# EasyEDA Pro project MSDRV3.eprj, board PCB8
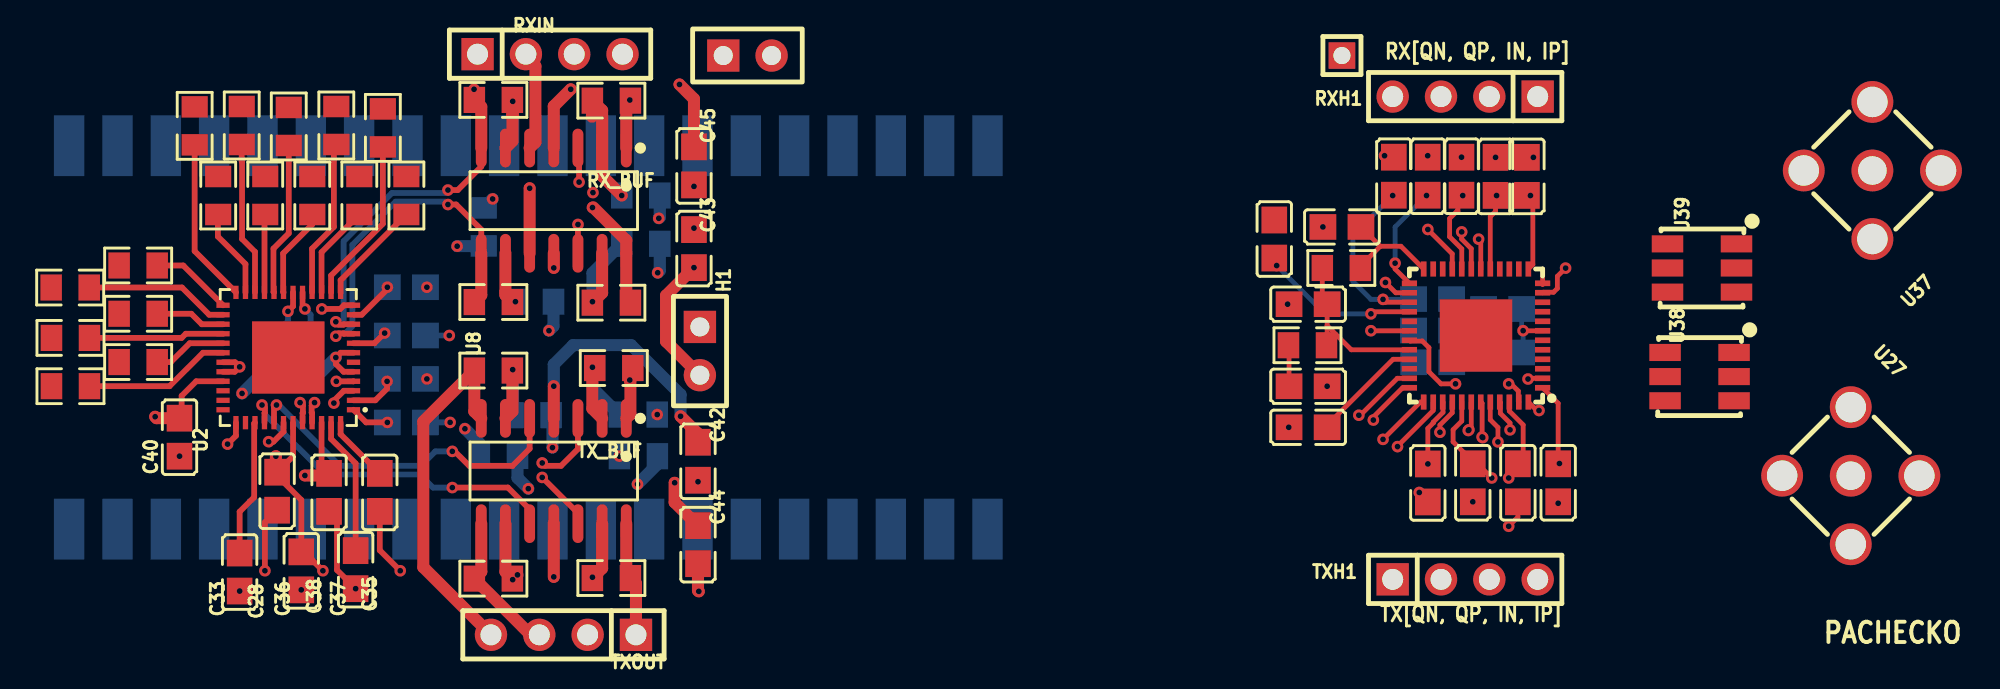
[diagram p14: board, top side]
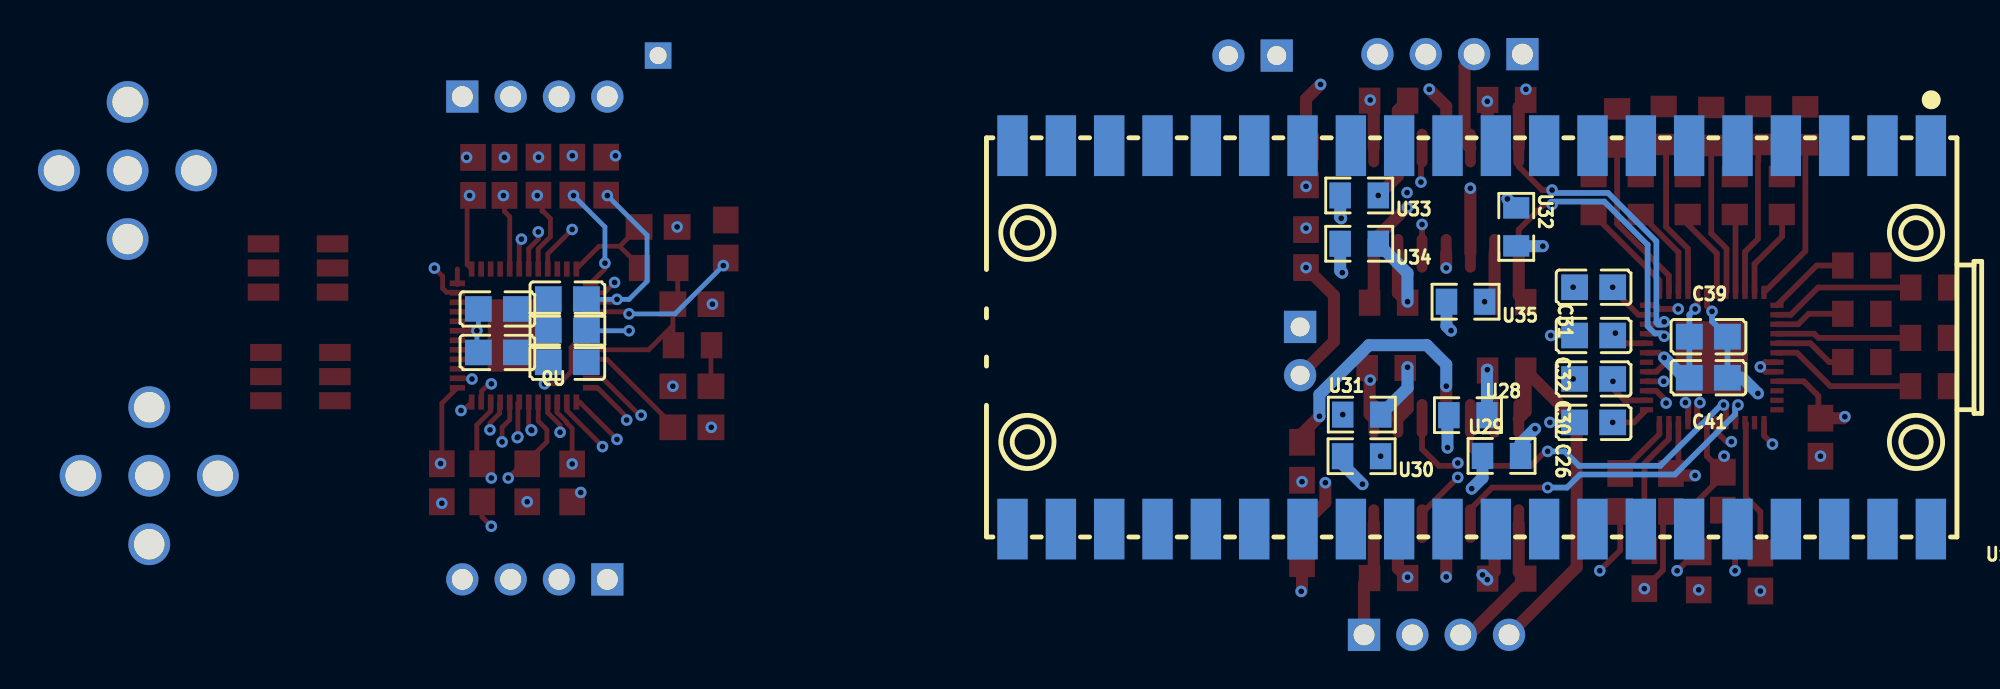
[diagram p15: board, bottom side, seen from below]

No outline. copper layers: Top Layer, Inner1, Inner2, Inner3, Inner4, Bottom Layer. Coordinates in mm from the lowest, leftmost part position.
Stack: Top Layer 0.035mm 外层铜厚1oz / Dielectric1 0.0994mm 3313 RC57% 4.2mil / Inner1 0.0152mm 内层铜厚 / Dielectric2 0.55mm 0.55mm H/H不含铜 / Inner2 0.0152mm 内层铜厚 / Dielectric3 0.1088mm 2116 RC54% 4.9mil / Inner3 0.0152mm 内层铜厚 / Dielectric4 0.55mm 0.55mm H/H不含铜 / Inner4 0.0152mm 内层铜厚 / Dielectric5 0.0994mm 3313 RC57% 4.2mil / Bottom Layer 0.035mm 外层铜厚1oz

## Design rules (mm)
template: JLCPCB Capability(Two Layers Board)
spacing copperThickness1oz (default): track to track 0.102, other pairs 0.152 to 0.3
spacing copperThickness2oz: track to track 0.203, other pairs 0.152 to 0.3
track width copperThickness1oz (default): min 0.127, default 0.254, max 2.54
track width copperThickness2oz: min 0.203, default 0.254, max 2.54
differential pair differentialPair (default): width min 0.127, default 0.254, max 2.54; gap min 0.152, default 0.152
via viaSize (default): diameter min 0.5, default 0.61, max 10; hole min 0.3, default 0.305, max 6.3

## Placement (name value [footprint] x y rotation side)
C18  100nF  [C0805]  65.06 10.92 0 top
C19  100nF  [C0805]  63.28 20.82 270 top
C20  100pF  [C0805]  66.83 21.46 0 top
C21  2200pF  [C0805]  65.06 13.08 180 top
C22  68pF  [C0805]  65.06 17.39 0 top
C26  330nF  [C0805]  17.67 11.18 180 bottom
C28  100nF  [C0805]  10.87 7.56 90 top
C30  100nF  [C0805]  17.67 13.46 0 bottom
C31  100nF  [C0805]  17.67 18.29 180 bottom
C32  100nF  [C0805]  17.67 15.75 180 bottom
C33  100nF  [C0805]  8.91 3.3 270 top
C35  330nF  [C0805]  16.27 7.49 270 top
C36  100nF  [C0805]  12.14 3.37 90 top
C37  330nF  [C0805]  15 3.43 90 top
C38  100nF  [C0805]  13.6 7.49 90 top
C39  100nF  [C0805]  11.64 15.68 180 bottom
C40  100nF  [C0805]  5.75 10.4 90 top
C41  100nF  [C0805]  11.64 13.53 180 bottom
C42  330nF  [C0805]  32.99 9.13 90 top
C43  330nF  [C0805]  32.78 20.32 270 top
C44  330nF  [C0805]  32.99 4.74 270 top
C45  330nF  [C0805]  32.78 24.67 90 top
CLNA  100pF  [C0805]  78.2 8 270 top
CPA  100nF  [C0805]  76.56 24.12 90 top
CPA1  10uF  [C0805]  75.28 17.14 180 bottom
CPA2  10uF  [C0805]  75.28 14.86 180 bottom
CPLL  100pF  [C0805]  73.12 24.13 90 top
CRXMX  100pF  [C0805]  76.08 8 270 top
CTXMX  100pF  [C0805]  74.91 24.12 90 top
CVCCCP  10nF  [C0805]  71.34 24.13 90 top
CVCO0  100pF  [C0805]  71.6 17.66 0 bottom
CVCO1  100pF  [C0805]  71.6 16.01 0 bottom
CVCO2  100pF  [C0805]  71.6 14.34 0 bottom
CVRXA  100pF  [C0805]  71.35 7.99 270 top
CVRXF  100pF  [C0805]  73.71 8 270 top
CVXTAL  100pF  [C0805]  69.56 24.13 90 top
H1  -  [HDR-TH_2P-P2.54-V-F]  33.09 14.93 270 top
H12  -  [HDR-TH_1P-V-M_XKB_X4611WV-01I-C28D40]  66.83 30.48 180 top
H21  -  [HDR-TH_2P-P2.54-V-F]  35.59 30.48 0 top
RX_BUF  CLC4601ISO14X  [SOIC-14_L8.7-W3.9-P1.27-LS6.0-BL]  25.41 22.84 180 top
RXH1  -  [HDR-TH_4P-P2.54-V-M]  73.31 28.32 180 top
RXIN  -  [HDR-TH_4P-P2.54-V-F]  25.22 30.55 0 top
TX_BUF  CLC4601ISO14X  [SOIC-14_L8.7-W3.9-P1.27-LS6.0-BL]  25.41 8.62 180 top
TXH1  -  [HDR-TH_4P-P2.54-V-M]  73.31 2.92 0 top
TXOUT  -  [HDR-TH_4P-P2.54-V-F]  25.92 0 180 top
U1  PICO  [COMM-SMD_L51.0-W21.0-P2.54_SC0916]  24.39 15.65 0 bottom
U2  MAX5864ETM+  [QFN-48_L7.0-W7.0-P0.50-BL-EP5.1]  11.46 14.59 90 top
U3  1120  [R0805]  22.24 2.96 0 top
U4  1120  [R0805]  28.44 28.1 0 top
U5  1120  [R0805]  28.44 17.47 180 top
U6  1120  [R0805]  22.24 17.51 0 top
U7  1120  [R0805]  22.24 28.14 180 top
U8  1120  [R0805]  22.24 13.9 180 top
U9  MAX2831ETM+T  [TQFN-48_L7.0-W7.0-P0.50-TL-EP5.6]  73.88 15.75 180 top
U10  1120  [R0805]  28.44 2.99 180 top
U11  100  [R0805]  0.02 13.08 0 top
U12  100  [R0805]  3.57 14.35 0 top
U13  100  [R0805]  0.02 15.62 0 top
U14  100  [R0805]  3.57 16.89 0 top
U15  100  [R0805]  0 18.27 0 top
U16  100  [R0805]  3.57 19.43 0 top
U17  100  [R0805]  6.54 26.78 90 top
U18  100  [R0805]  7.78 23.11 90 top
U19  100  [R0805]  9.01 26.8 90 top
U20  100  [R0805]  10.25 23.11 90 top
U21  100  [R0805]  11.49 26.75 90 top
U22  100  [R0805]  12.72 23.11 90 top
U23  100  [R0805]  13.99 26.8 90 top
U24  100  [R0805]  15.2 23.11 90 top
U25  100  [R0805]  16.43 26.67 90 top
U26  100  [R0805]  17.67 23.11 90 top
U27  MCX5.08-H5  [SMA-TH_MCX5.08-H5]  93.57 8.37 315 top
U28  1120  [R0805]  24.27 11.56 0 bottom
U29  1120  [R0805]  22.51 9.41 180 bottom
U30  1120  [R0805]  29.86 9.4 0 bottom
U31  1120  [R0805]  29.85 11.59 180 bottom
U32  1120  [R0805]  21.73 21.46 270 bottom
U33  1120  [R0805]  29.99 23.11 0 bottom
U34  1120  [R0805]  29.99 20.57 0 bottom
U35  1120  [R0805]  24.4 17.53 0 bottom
U36  1120  [R0805]  28.57 14.04 0 top
U37  MCX5.08-H5  [SMA-TH_MCX5.08-H5]  94.71 24.43 45 top
U38  TCM2-43X+  [IND-SMD_6P-L4.1-W3.8-P1.27-TL]  85.63 13.58 270 top
U39  TCM2-43X+  [IND-SMD_6P-L4.1-W3.8-P1.27-TL]  85.76 19.3 270 top
U40  1.2K  [R0805]  65.02 15.24 180 top
U41  750  [R0805]  66.8 19.3 0 top

## Footprints (pads in the part's own frame, mm; a bottom-side part is the same pattern mirrored in y, then rotated)
C0805
  rect 1.41x1.35 smd: 1(-1,0) 2(1,0)
COMM-SMD_L51.0-W21.0-P2.54_SC0916
  rect 1.6x3.2 smd: 1(-24.445,-10.088) 2(-21.905,-10.088) 3(-19.365,-10.088) 4(-16.825,-10.088) 5(-14.285,-10.088) 6(-11.745,-10.088) 7(-9.205,-10.088) 8(-6.665,-10.088) 9(-4.125,-10.088) 10(-1.585,-10.088) 11(0.955,-10.088) 12(3.495,-10.088) 13(6.035,-10.088) 14(8.575,-10.088) 15(11.115,-10.088) 16(13.655,-10.088) 17(16.195,-10.088) 18(18.735,-10.088) 19(21.275,-10.088) 20(23.815,-10.088) 21(23.815,10.088) 22(21.275,10.088) 23(18.735,10.088) 24(16.195,10.088) 25(13.655,10.088) 26(11.115,10.088) 27(8.575,10.088) 28(6.035,10.088) 29(3.495,10.088) 30(0.955,10.088) 31(-1.585,10.088) 32(-4.125,10.088) 33(-6.665,10.088) 34(-9.205,10.088) 35(-11.745,10.088) 36(-14.285,10.088) 37(-16.825,10.088) 38(-19.365,10.088) 39(-21.905,10.088) 40(-24.445,10.088)
HDR-TH_1P-V-M_XKB_X4611WV-01I-C28D40
  rect 1.4x1.4 hole 0.9: 1(0,0)
HDR-TH_2P-P2.54-V-F
  rect 1.7x1.7 hole 1: 1(-1.27,0)
  round 1.7 hole 1: 2(1.27,0)
HDR-TH_4P-P2.54-V-F
  rect 1.7x1.7 hole 1.1: 1(-3.81,0)
  round 1.7 hole 1.1: 2(-1.27,0) 3(1.27,0) 4(3.81,0)
HDR-TH_4P-P2.54-V-M
  rect 1.7x1.7 hole 1.1: 1(-3.81,0)
  round 1.7 hole 1.1: 2(-1.27,0) 3(1.27,0) 4(3.81,0)
IND-SMD_6P-L4.1-W3.8-P1.27-TL
  rect 0.9x1.657 smd: 1(-1.27,1.813) 2(0,1.813) 3(1.27,1.813) 4(1.27,-1.813) 5(0,-1.813) 6(-1.27,-1.813)
QFN-48_L7.0-W7.0-P0.50-BL-EP5.1
  rect 0.28x0.7 smd: 1(-2.75,-3.428) 2(-2.25,-3.428) 3(-1.75,-3.428) 4(-1.25,-3.428) 5(-0.75,-3.428) 6(-0.25,-3.428) 7(0.25,-3.428) 8(0.75,-3.428) 9(1.25,-3.428) 10(1.75,-3.428) 11(2.25,-3.428) 12(2.75,-3.428) 25(2.75,3.428) 26(2.25,3.428) 27(1.75,3.428) 28(1.25,3.428) 29(0.75,3.428) 30(0.25,3.428) 31(-0.25,3.428) 32(-0.75,3.428) 33(-1.25,3.428) 34(-1.75,3.428) 35(-2.25,3.428) 36(-2.75,3.428)
  rect 0.7x0.28 smd: 13(3.428,-2.75) 14(3.428,-2.25) 15(3.428,-1.75) 16(3.428,-1.25) 17(3.428,-0.75) 18(3.428,-0.25) 19(3.428,0.25) 20(3.428,0.75) 21(3.428,1.25) 22(3.428,1.75) 23(3.428,2.25) 24(3.428,2.75) 37(-3.428,2.75) 38(-3.428,2.25) 39(-3.428,1.75) 40(-3.428,1.25) 41(-3.428,0.75) 42(-3.428,0.25) 43(-3.428,-0.25) 44(-3.428,-0.75) 45(-3.428,-1.25) 46(-3.428,-1.75) 47(-3.428,-2.25) 48(-3.428,-2.75)
  rect 3.81x3.81 smd: 49(0,0)
R0805
  rect 1.133x1.377 smd: 1(-1,0) 2(1,0)
SMA-TH_MCX5.08-H5
  round 2.2 hole 1.6: 1(-2.55,-2.55) 2(-2.55,2.55) 3(2.55,2.55) 4(2.55,-2.55)
  round 2.2 hole 1.5: 5(0,0)
SOIC-14_L8.7-W3.9-P1.27-LS6.0-BL
  oval 0.574x2.038 smd: 1(-3.81,-2.769) 2(-2.54,-2.769) 3(-1.27,-2.769) 4(0,-2.769) 5(1.27,-2.769) 6(2.54,-2.769) 7(3.81,-2.769) 8(3.81,2.769) 9(2.54,2.769) 10(1.27,2.769) 11(0,2.769) 12(-1.27,2.769) 13(-2.54,2.769) 14(-3.81,2.769)
TQFN-48_L7.0-W7.0-P0.50-TL-EP5.6
  rect 0.8x0.3 smd: 1(-3.5,2.751) 2(-3.5,2.251) 3(-3.5,1.75) 4(-3.5,1.251) 5(-3.5,0.75) 6(-3.5,0.252) 7(-3.5,-0.249) 8(-3.5,-0.75) 9(-3.5,-1.25) 10(-3.5,-1.75) 11(-3.5,-2.249) 12(-3.5,-2.748) 25(3.5,-2.748) 26(3.5,-2.249) 27(3.5,-1.75) 28(3.5,-1.25) 29(3.5,-0.75) 30(3.5,-0.249) 31(3.5,0.252) 32(3.5,0.75) 33(3.5,1.251) 34(3.5,1.75) 35(3.5,2.251) 36(3.5,2.751)
  rect 0.3x0.8 smd: 13(-2.751,-3.5) 14(-2.251,-3.5) 15(-1.75,-3.5) 16(-1.25,-3.5) 17(-0.75,-3.5) 18(-0.251,-3.5) 19(0.249,-3.5) 20(0.75,-3.5) 21(1.25,-3.5) 22(1.75,-3.5) 23(2.251,-3.5) 24(2.751,-3.5) 37(2.751,3.5) 38(2.251,3.5) 39(1.75,3.5) 40(1.25,3.5) 41(0.75,3.5) 42(0.251,3.5) 43(-0.251,3.5) 44(-0.75,3.5) 45(-1.25,3.5) 46(-1.75,3.5) 47(-2.251,3.5) 48(-2.751,3.5)
  rect 3.81x3.81 smd: 49(0,0.001)

## Nets
+5V: C42.2 C45.2 H1.1 RX_BUF.4 TX_BUF.4
-5V: C43.2 C44.2 H1.2 RX_BUF.11 TX_BUF.11
GND: C18.1 C20.1 C21.1 C22.1 C26.1 C28.1 C30.2 C31.1 C32.1 C33.2 C35.2 C36.1 C37.1 C38.1 C39.1 C40.1 C41.1 C42.1 C43.1 C44.1 C45.1 CLNA.2 CPA.2 CPA1.2 CPA2.2 CPLL.2 CRXMX.2 CTXMX.2 CVCCCP.2 CVCO0.2 CVCO1.2 CVCO2.2 CVRXA.2 CVRXF.2 CVXTAL.2 U2.5 U2.7 U2.12 U2.17 U2.31 U2.32 U2.37 U2.42 U9.2 U9.26 U9.31 U9.47 U27.1 U27.2 U27.3 U27.4 U28.2 U29.2 U30.2 U31.1 U32.2 U33.2 U34.2 U35.2 U37.1 U37.2 U37.3 U37.4 U38.1 U38.2 U39.1 U39.2
3.3: C28.2 C30.1 C31.2 C32.2 C33.1 C36.2 C38.2 C39.2 C40.2 C41.2 CLNA.1 CPA.1 CPA1.1 CPA2.1 CPLL.1 CRXMX.1 CTXMX.1 CVCCCP.1 CVCO0.1 CVCO1.1 CVCO2.1 CVRXA.1 CVRXF.1 CVXTAL.1 U2.2 U2.8 U2.11 U2.18 U2.33 U2.39 U2.43 U2.46 U9.1 U9.7 U9.13 U9.17 U9.20 U9.25 U9.27 U9.30 U9.39 U9.41 U9.46
$1I595/BYPASS: C18.2 U9.33
$1I595/CLKBUF: H12.1 U9.21
$1I595/CPOUT: C20.2 U9.24 U41.2
$1I595/CS#: U9.15
$1I595/D1: U9.23
$1I595/D2: U9.11
$1I595/D3: U9.8
$1I595/D4: U9.34
$1I595/D5: U9.14
$1I595/D6: U9.3
$1I595/D7: U9.6
$1I595/DIN: U9.19
$1I595/PLL_LOCK: U9.22
$1I595/PLLCLK: C19.1 H21.2
$1I595/RSSI: U9.16
$1I595/RXHP: U9.40
$1I595/RXIN: RXH1.2 U9.37
$1I595/RXIP: RXH1.1 U9.38
$1I595/RXN: U9.5 U38.6
$1I595/RXP: U9.4 U38.4
$1I595/RXQN: RXH1.4 U9.35
$1I595/RXQP: RXH1.3 U9.36
$1I595/RXTX_MODE: U9.48
$1I595/SCLK: U9.18
$1I595/SHDN#: U9.12
$1I595/TUNE: C22.2 U9.32 U40.1 U41.1
$1I595/TXIN: TXH1.3 U9.44
$1I595/TXIP: TXH1.4 U9.45
$1I595/TXN: U9.10 U39.6
$1I595/TXP: U9.9 U39.4
$1I595/TXQN: TXH1.1 U9.42
$1I595/TXQP: TXH1.2 U9.43
$1I595/XTAL: C19.2 U9.28
$1I715/BBC_CLK: U2.6
$1I715/BBC_DA0: U26.2
$1I715/BBC_DA1: U25.2
$1I715/BBC_DA2: U24.2
$1I715/BBC_DA3: U23.2
$1I715/BBC_DA4: U22.2
$1I715/BBC_DA5: U21.2
$1I715/BBC_DA6: U20.2
$1I715/BBC_DA7: U19.2
$1I715/BBC_DD0: U18.2
$1I715/BBC_DD1: U17.2
$1I715/BBC_DD2: U16.1
$1I715/BBC_DD3: U15.1
$1I715/BBC_DD4: U14.1
$1I715/BBC_DD5: U13.1
$1I715/BBC_DD6: U12.1
$1I715/BBC_DD7: U11.1
$1I715/BBC_IN: TX_BUF.12 U2.44
$1I715/BBC_IP: TX_BUF.3 U2.45
$1I715/BBC_QN: TX_BUF.10 U2.40
$1I715/BBC_QP: TX_BUF.5 U2.41
$1I715/CS: U2.36
$1I715/DIN: U2.34
$1I715/RX_BBCIN: RX_BUF.1 U2.4 U4.2
$1I715/RX_BBCIP: RX_BUF.14 U2.3 U5.1
$1I715/RX_BBCQN: RX_BUF.8 U2.9 U6.1
$1I715/RX_BBCQP: RX_BUF.7 U2.10 U7.2
$1I715/RXIN: RX_BUF.3 RXIN.4
$1I715/RXIP: RX_BUF.12 RXIN.3
$1I715/RXQN: RX_BUF.10 RXIN.1
$1I715/RXQP: RX_BUF.5 RXIN.2
$1I715/SCLK: U2.35
$1I715/TXIN: TX_BUF.14 TXOUT.1 U10.1
$1I715/TXIP: TX_BUF.1 TXOUT.2 U36.2
$1I715/TXQN: TX_BUF.8 TXOUT.3 U3.1
$1I715/TXQP: TX_BUF.7 TXOUT.4 U8.2
$1I595/$1N13355: U27.5 U38.3
$1I595/$1N19235: H21.1
$1I595/$1N20170: U37.5 U39.3
$1I595/$1N20400: C21.2 U40.2
$1I715/$1N3982: C37.2 U2.47
$1I715/$1N8783: RX_BUF.2 U4.1 U33.1
$1I715/$1N8787: RX_BUF.6 U7.1 U32.1
$1I715/$1N8791: RX_BUF.9 U6.2 U35.1
$1I715/$1N8799: RX_BUF.13 U5.2 U34.1
$1I715/$1N9382: TX_BUF.2 U31.2 U36.1
$1I715/$1N9385: TX_BUF.6 U8.1 U28.1
$1I715/$1N9388: TX_BUF.13 U10.2 U30.1
$1I715/$1N9391: TX_BUF.9 U3.2 U29.1
$1I715/$1N10591: U2.30 U11.2
$1I715/$1N10629: U2.29 U12.2
$1I715/$1N10667: U2.28 U13.2
$1I715/$1N10705: U2.27 U14.2
$1I715/$1N10743: U2.26 U15.2
$1I715/$1N10781: U2.25 U16.2
$1I715/$1N10830: U2.24 U17.1
$1I715/$1N10868: U2.23 U18.1
$1I715/$1N10906: U2.22 U19.1
$1I715/$1N10944: U2.21 U20.1
$1I715/$1N10982: U2.20 U21.1
$1I715/$1N11020: U2.19 U22.1
$1I715/$1N11058: U2.16 U23.1
$1I715/$1N11162: U2.15 U24.1
$1I715/$1N11200: U2.14 U25.1
$1I715/$1N11238: U2.13 U26.1
$1I715/$1N11679: C35.1 U2.48
$1I715/$1N11690: C26.2 U2.1

Pads without a net: U1 1 2 3 4 5 6 7 8 9 10 11 12 13 14 15 16 17 18 19 20 21 22 23 24 25 26 27 28 29 30 31 32 33 34 35 36 37 38 39 40; U2 38 49; U9 29 49; U38 5; U39 5

## Via types
v1: diameter 0.61, hole 0.305, Top Layer to Bottom Layer, 128 vias

## Routing (per net, layer and track width the routed paths; a pad name or vN(x,y) marks a point on that pad's centre or on a via; arc(x,y) is an arc through that point)
+5V: length 47
  Top Layer w0.635: v1(26.31,28.7) 25.41,27.81 RX_BUF.4 ; v1(32.08,11.5) 32.95,10.63 32.95,10.13 ; v1(32.02,28.96) 32.78,28.19 C45.2 ; TX_BUF.4 v1(25.41,13.08)
  Inner2 w0.635: v1(32.02,28.96) 26.56,28.96 v1(26.31,28.7)
  Inner3 w0.635: v1(32.02,28.96) 32.4,28.96 34.49,26.87 34.49,17.6 H1.1 31.44,14.55 31.44,12.52 32.08,11.88 v1(32.08,11.5)
  Bottom Layer w0.635: v1(32.08,11.5) 32.08,12.64 29.48,15.24 26.43,15.24 25.41,14.22 v1(25.41,13.08)
-5V: length 41.4
  Top Layer w0.635: v1(33.04,2.29) 32.99,2.33 C44.2 ; v1(25.42,19.3) 25.42,20.07 ; v1(32.78,19.32) 31.32,17.85 31.32,15.44 H1.2 ; 25.41,3.05 TX_BUF.11
  Inner2 w0.635: v1(33.04,2.29) 29.61,2.29 29.23,1.91 26.81,1.91 25.67,3.05 v1(25.42,3.05) ; v1(25.42,19.3) 26.81,20.7 31.4,20.7 v1(32.78,19.32)
  Inner3 w0.635: v1(33.04,2.29) 34.49,3.74 34.49,11.88 33.09,13.28 H1.2
GND: length 52.7
  Top Layer w0.254: U9.2 76.85,13.5 76.82,13.46 v1(76.61,13.46) ; U9.26 69.66,18 v1(69.12,18.54) ; v1(75.6,5.71) 76.08,6.2 CRXMX.2 ; v1(72.8,13.2) 72.04,13.2 71.41,13.84 71.41,15.11 71.06,15.45 70.42,15.45 U9.31 ; 76.13,12.25 76.11,12.27 76.11,12.82 75.72,13.2 v1(75.6,13.2)
  Top Layer w0.305: v1(15,2.43) 14.02,3.41 14.02,6.08 C38.1 ; U2.37 8.71,10.47 v1(8.27,10.03) ; v1(12.33,17.14) 12.21,17.27 U2.17 ; U2.5 14.37,13.84 13.96,14.25 v1(13.96,14.59) 14.21,14.84 U2.7 ; v1(10.23,3.37) 10.23,5.92 C28.1 ; 8.03,14.34 8.66,14.34 v1(8.91,14.1) 8.65,13.84 U2.32 ; v1(10.43,10.16) 10.68,10.16 11.21,10.69 U2.42 ; v1(13.22,17.14) 14.19,17.14 14.39,17.34 14.89,17.34 ; C35.2 16.27,4.44 v1(17.35,3.37)
  Top Layer w0.635: v1(31.77,8) 31.77,6.97 C44.1
  Bottom Layer w0.305: v1(19.92,15.75) C32.1 ; v1(12.33,17.14) 12.64,16.84 C39.1 C41.1 ; v1(19.97,11.18) C26.1
  Bottom Layer w0.635: v1(20.34,20.45) 21.72,20.45 U32.2 ; v1(25.35,9.85) 25.35,11.48 U28.2 ; U33.2 30.99,21.97 v1(30.93,21.91) ; v1(30.88,19.05) 30.99,19.16 U34.2 ; v1(29.82,7.92) 30.86,8.97 U30.2 ; U29.2 21.51,10.08 v1(20.75,10.84) ; v1(13.96,14.59) 12.9,13.53 C41.1 ; v1(25.16,16) 25.4,16.24 U35.2
  vias: v1(5.75,9.4) v1(8.91,2.3) v1(12.14,2.37) v1(18.75,18.29) v1(18.75,13.46) v1(30.85,11.59) v1(32.78,23.59) v1(32.78,21.4) v1(32.99,8.05) v1(63.98,17.39) v1(64.04,10.92) v1(65.83,21.46) v1(66.06,13.08) v1(69.07,25.21) v1(70.9,7.49) v1(71.34,25.21) v1(73.12,25.13) v1(73.71,7) v1(74.91,25.12) v1(76.9,25.12) v1(78.2,6.92)
3.3: length 95
  Top Layer w0.254: v1(73.18,23.11) 72.93,22.86 72.93,22.29 72.88,22.29 72.49,21.9 72.49,20.94 73.13,20.31 73.13,19.25 ; 73.69,9.14 72.68,10.16 72.68,10.79 73.13,11.25 73.13,12.25 ; v1(68.99,17.65) 69.15,17.5 U9.27 ; CVRXF.1 73.96,9 v1(74.71,8.25) ; U9.30 68.36,16 v1(68.36,16) ; v1(78.26,9.01) 78.2,9.08 78.2,12.18 U9.1 ; v1(69.63,19.55) 69.63,19.25 U9.25 ; U9.39 72.15,12.23 72.15,11.7 71.63,11.19 71.65,11.16 71.35,10.86 v1(71.35,8.99) ; 76.63,19.25 76.87,19.48 76.87,22.98 v1(76.74,23.11) ; U9.17 74.63,22 74.91,22.28 74.91,23.05 v1(74.96,23.11) ; U9.46 75.63,11.77 76.36,11.04 76.36,9.01 v1(75.6,8.25) 75.6,8.51 CRXMX.1 ; U9.7 76.36,16 v1(76.36,16)
  Top Layer w0.305: U2.11 15.32,16.84 16.67,18.19 v1(16.67,18.29) ; 14.89,15.34 15.99,15.34 v1(16.53,15.88) ; C40.2 5.86,11.51 5.86,12.57 6.62,13.34 8.03,13.34 ; U2.39 9.67,11.12 9.67,7.24 8.91,6.48 C33.1 ; U2.18 11.71,17.28 v1(11.45,17.02) ; v1(16.65,13.33) 16.65,12.95 16.04,12.34 14.89,12.34 ; v1(13.28,3.37) 12.29,4.37 C36.2 12.14,7.1 10.87,8.37 C28.2 11.71,9.39 U2.43 ; 13.46,8.64 13.21,8.89 U2.46
  Top Layer w0.635: C38.2 13.46,8.64 13.21,8.38 v1(12.33,8.38) ; C28.2 10.81,8.62 v1(10.81,9.4) ; v1(4.47,11.48) 4.54,11.4 C40.2
  Bottom Layer w0.254: CVCO0.1 70.58,17.65 v1(68.99,17.65) 68.36,17.65 67.41,18.59 67.41,21.02 v1(69.5,23.11) ; v1(69.63,19.55) 69.63,21.46 v1(71.28,23.11) ; v1(68.36,16) 70.58,16 CVCO1.1 ; CPA1.1 76.28,16.08 v1(76.36,16) 76.36,14.94 CPA2.1
  Bottom Layer w0.305: C41.2 C39.2 11.45,16.49 v1(11.45,17.02)
  Bottom Layer w0.635: C30.1 16.67,13.35 v1(16.65,13.33) ; C41.2 9.86,13.53 v1(9.03,12.7) ; v1(16.53,15.88) 16.65,15.75 C32.2
$1I595/BYPASS: length 5.9
  Top Layer w0.254: C18.2 66.06,11.03 69.52,14.5 U9.33
$1I595/CLKBUF: length 2.6
  Top Layer w0.254: U9.21 72.63,20.04 v1(71.35,21.33)
$1I595/CPOUT: length 5.9
  Top Layer w0.254: 67.83,19.43 67.8,19.39 U41.2 67.83,19.33 67.83,19.43 ; 67.83,19.43 68.85,20.44 ; 68.85,20.44 69.93,20.44 71.13,19.25 ; 68.85,20.44 C20.2
$1I595/D2: length 2.1
  Top Layer w0.254: U9.11 77.41,18.02 77.95,18.02 78.16,18.23 78.16,18.86 v1(78.59,19.29)
$1I595/DIN: length 2.2
  Top Layer w0.254: v1(73.13,21.2) 73.13,20.82 73.63,20.31 73.63,19.25
$1I595/RXHP: length 1.9
  Top Layer w0.254: U9.40 72.63,11.68 71.99,11.04 v1(71.99,10.66)
$1I595/RXIN: length 24.1
  Top Layer w0.254: v1(68.99,10.28) 70.96,12.25 71.13,12.25
  Inner2 w0.254: v1(68.99,10.28) 68.99,11.01 75.57,17.59 75.57,26.54 74.58,27.53 RXH1.2
$1I595/RXIP: length 24.6
  Top Layer w0.254: U9.38 71.63,11.8 69.76,9.93 v1(69.76,9.9)
  Inner2 w0.254: RXH1.1 77.12,27.68 75.98,26.54 75.98,17.42 69.76,11.2 v1(69.76,9.9)
$1I595/RXQN: length 21.7
  Top Layer w0.254: U9.35 69.74,13.5 67.8,11.55 v1(67.72,11.55)
  Inner2 w0.254: RXH1.4 69.5,27.43 70.14,26.79 70.14,20.32 70.39,20.06 70.39,15.87 68.49,13.97 68.49,12.31 v1(67.72,11.55)
$1I595/RXQP: length 21.5
  Top Layer w0.254: v1(68.49,11.3) 68.49,11.46 70.02,13 U9.36
  Inner2 w0.254: v1(68.49,11.3) 68.99,11.81 68.99,13.39 70.92,15.32 70.92,20.61 70.55,20.98 70.55,26.83 RXH1.3
$1I595/RXTX_MODE: length 0.7
  Top Layer w0.254: v1(77.19,11.8) 77.08,11.8 76.63,12.25
$1I595/SCLK: length 1.6
  Top Layer w0.254: U9.18 74.13,20.7 v1(74.02,20.82)
$1I595/SHDN#: length 0.8
  Top Layer w0.254: 77.38,18.42 U9.12 77.38,19.25
$1I595/TUNE: length 9
  Top Layer w0.254: U9.32 67.33,15 66.06,16.27 ; U40.1 66.06,15.27 66.06,16.27 ; 66.06,16.27 C22.2 65.8,17.65 U41.1
$1I595/TXIN: length 11.2
  Top Layer w0.254: U9.44 74.63,11.31 75.03,10.91 v1(75.03,10.15)
  Inner2 w0.254: v1(75.03,10.15) 75.78,9.41 75.78,9.19 76.84,8.12 76.84,5.47 75.65,4.28 75.65,3.98 TXH1.3
$1I595/TXIP: length 11.1
  Top Layer w0.254: U9.45 75.16,12.22 75.16,11.65 75.67,11.14 v1(75.67,10.78)
  Inner2 w0.254: TXH1.4 76.05,3.98 76.05,4.11 77.25,5.3 77.25,8.29 76.18,9.36 76.18,9.92 75.97,10.13 75.97,10.48 v1(75.67,10.78)
$1I595/TXQN: length 11.1
  Top Layer w0.254: U9.42 73.63,10.91 v1(73.51,10.78) v1(73.47,10.75)
  Inner2 w0.254: TXH1.1 70.57,3.98 70.57,4.28 72.52,6.23 72.52,8.51 73.51,9.5 v1(73.51,10.78)
$1I595/TXQP: length 11.2
  Top Layer w0.254: 74.2,10.41 74.2,12.18 U9.43 ; v1(74.2,10.41) v1(74.24,10.37)
  Inner2 w0.254: v1(74.24,10.37) 74.24,9.65 72.93,8.34 72.93,6.07 70.97,4.11 70.97,3.98 TXH1.2
$1I595/XTAL: length 8.1
  Top Layer w0.254: v1(68.36,16.89) 68.47,17 U9.28
  Bottom Layer w0.254: v1(63.41,19.43) 65.95,16.89 v1(68.36,16.89)
$1I715/BBC_IN: length 18.9
  Top Layer w0.305: v1(12.08,12.22) 12.23,12.06 12.23,11.69 12.21,11.66 U2.44 ; TX_BUF.12 26.68,6.4 v1(24.81,8.28)
  Inner2 w0.305: v1(12.08,12.22) 12.23,12.06 12.23,11.72 15.52,8.43 24.65,8.43 v1(24.81,8.28)
$1I715/BBC_IP: length 18.8
  Top Layer w0.305: v1(12.84,12.22) 12.69,12.06 12.69,11.69 12.71,11.66 12.71,11.16 ; TX_BUF.3 26.68,9.78 25.8,8.89 24.96,8.89 v1(24.81,9.04)
  Inner2 w0.305: v1(24.81,9.04) 24.65,8.89 15.71,8.89 12.69,11.91 12.69,12.06 v1(12.84,12.22)
$1I715/BBC_QN: length 18.3
  Top Layer w0.305: TX_BUF.10 24.15,6.6 23,7.75 v1(20.08,7.75) ; U2.40 10.21,11.66 10.23,11.69 10.23,11.94 v1(10.08,12.09)
  Bottom Layer w0.305: v1(20.08,7.75) 19.07,7.75 18.38,8.43 13.4,8.43 10.23,11.6 10.23,11.94 v1(10.08,12.09)
$1I715/BBC_QP: length 18.2
  Top Layer w0.305: U2.41 10.71,11.96 v1(10.84,12.09) ; v1(20.08,9.65) 20.21,9.65 20.97,8.89 23.25,8.89 24.15,9.79 24.15,11.39
  Bottom Layer w0.305: v1(10.84,12.09) 10.97,12.09 14.17,8.89 18.43,8.89 19.19,9.65 v1(20.08,9.65)
$1I715/RX_BBCIN: length 26.8
  Top Layer w0.305: v1(13.99,13.33) 14.88,13.33 14.89,13.34
  Top Layer w0.635: RX_BUF.1 29.22,27.89 U4.2 29.41,28.13
  Inner2 w0.305: 27.49,23.28 v1(27.47,23.27) 27.32,23.11 24.91,23.11 16.65,14.86 15.81,14.86 14.26,13.32 14,13.32 v1(13.99,13.33)
  Inner2 w0.635: 27.49,23.28 29.22,25.02 29.22,27.95 v1(29.41,28.14)
$1I715/RX_BBCIP: length 25.2
  Top Layer w0.305: 27.49,22.49 27.46,22.49 v1(27.45,22.48) ; U2.3 14.38,12.84 13.86,12.32 v1(13.86,12.19)
  Top Layer w0.635: 27.49,22.49 29.22,20.75 RX_BUF.14 29.22,17.69 U5.1
  Inner2 w0.305: v1(13.86,12.19) 14.2,12.19 16.41,14.4 16.84,14.4 25.1,22.66 27.27,22.66 v1(27.45,22.48)
$1I715/RX_BBCQN: length 18.7
  Top Layer w0.305: v1(19.85,22.64) 20.28,22.64 21.6,21.32 RX_BUF.8 ; v1(13.96,15.71) 14.11,15.86 14.37,15.86 14.39,15.84 U2.9
  Top Layer w0.635: RX_BUF.8 21.6,17.87 U6.1
  Bottom Layer w0.305: v1(19.85,22.64) 19.7,22.79 17.1,22.79 14.83,20.52 14.83,16.24 14.45,15.86 14.11,15.86 v1(13.96,15.71)
$1I715/RX_BBCQP: length 18.9
  Top Layer w0.305: U7.2 21.22,28.16 v1(21.22,28.7) ; v1(13.96,16.47) 14.11,16.32 14.37,16.32 14.39,16.34 14.89,16.34 ; v1(19.85,23.4) 20.37,23.4 21.6,24.64 RX_BUF.7
  Top Layer w0.635: U7.2 21.6,27.78 RX_BUF.7
  Bottom Layer w0.305: v1(19.85,23.4) 19.7,23.25 16.91,23.25 14.37,20.71 14.37,16.43 14.26,16.32 14.11,16.32 v1(13.96,16.47)
$1I715/RXIN: length 9.9
  Top Layer w0.305: RX_BUF.3 26.74,25.55 v1(26.74,23.82)
  Inner3 w0.635: v1(26.74,23.82) 28.52,25.6 28.52,30.04 28.97,30.49 28.97,30.99
$1I715/RXIP: length 11.4
  Top Layer w0.305: v1(26.68,21.59) RX_BUF.12
  Inner3 w0.635: v1(26.69,21.59) 25.43,22.85 25.43,28.92 26.49,29.98 RXIN.3
$1I715/RXQN: length 11.8
  Top Layer w0.635: v1(24.15,23.49) RX_BUF.10
  Inner3 w0.635: RXIN.1 21.79,30.55 22.11,30.23 22.11,25.53 v1(24.15,23.49)
$1I715/RXQP: length 5.7
  Top Layer w0.635: 23.89,30.99 23.89,30.48 24.45,29.92 24.45,25.92 RX_BUF.5
$1I715/TXIN: length 6.1
  Top Layer w0.635: 29.73,0 29.73,2.69 U10.1 29.22,3.2 TX_BUF.14
$1I715/TXIP: length 17.7
  Top Layer w0.635: 29.44,13.44 29.44,11.6 TX_BUF.1 ; 29.44,13.44 29.44,13.56 29.57,13.69 U36.2 ; 29.44,13.44 v1(29.41,13.4)
  Inner3 w0.635: v1(29.41,13.4) 29.41,12.13 26.49,9.21 26.49,0.7 27.19,0
$1I715/TXQN: length 7.7
  Top Layer w0.635: TXOUT.3 24.2,0 U3.1 21.6,3.32 TX_BUF.8
$1I715/TXQP: length 19.2
  Top Layer w0.635: TX_BUF.7 21.24,11.75 U8.2 18.56,11.22 18.56,3.56 TXOUT.4
$1I595/$1N20400: length 2.2
  Top Layer w0.254: U40.2 64.06,15.2 C21.2
$1I715/$1N3982: length 7.3
  Top Layer w0.305: 13.71,11.16 13.71,10.31 15,9.02 C37.2
$1I715/$1N8783: length 6.5
  Top Layer w0.635: 27.42,27.26 27.42,28.09 U4.1 27.95,27.59 RX_BUF.2 27.95,24.15 v1(28.99,23.11)
$1I715/$1N8787: length 11.3
  Top Layer w0.635: 23.24,27.26 U7.1 23.29,28.1 23.26,27.57 ; 23.24,27.26 23.24,25.98 RX_BUF.6 ; 23.24,27.26 23.26,27.57 ; 23.24,27.26 23.26,27.28 23.26,27.57 ; v1(23.26,28.07) 23.26,27.57
  Inner2 w0.635: v1(23.26,28.07) 23.26,23.99 v1(22.2,22.93) U32.1
  Bottom Layer w0.635: v1(22.2,22.93) U32.1
$1I715/$1N8791: length 3.7
  Top Layer w0.635: 22.87,18.05 22.87,17.87 U6.2 23.24,17.69 ; 22.87,18.05 RX_BUF.9 ; 22.87,18.05 23.24,17.69 ; 23.29,17.75 23.24,17.71 23.24,17.69 ; 23.24,17.69 v1(23.4,17.53)
$1I715/$1N8799: length 6.6
  Top Layer w0.635: RX_BUF.13 27.95,17.99 U5.2 27.44,17.52 v1(27.45,17.53)
  Bottom Layer w0.635: v1(27.45,17.53) 27.45,19.03 U34.1
$1I715/$1N9382: length 6
  Top Layer w0.635: v1(27.45,14.08) 27.44,14.07 27.44,11.9 TX_BUF.2
  Bottom Layer w0.635: v1(27.45,14.08) 27.45,12.99 U31.2
$1I715/$1N9385: length 5.1
  Top Layer w0.635: v1(23.26,13.95) 23.26,13.92 U8.1 23.24,11.75 TX_BUF.6
  Bottom Layer w0.635: U28.1 23.27,13.94 v1(23.26,13.95)
$1I715/$1N9388: length 10.1
  Top Layer w0.635: TX_BUF.13 27.95,3.5 U10.2 27.44,3.02 v1(27.45,3.03)
  Inner3 w0.635: v1(27.45,3.03) 28.86,4.44 v1(28.86,9.4)
$1I715/$1N9391: length 10.2
  Top Layer w0.635: TX_BUF.9 22.87,3.32 U3.2 23.24,2.92 v1(23.26,2.9)
  Inner3 w0.635: v1(23.51,3.15) 24.08,3.72 v1(24.08,7.69)
  Bottom Layer w0.635: U29.1 23.51,8.26 v1(24.08,7.69) ; v1(23.51,3.15) v1(23.26,2.9)
$1I715/$1N10591: length 7.7
  Top Layer w0.305: U2.30 6.98,14.84 5.22,13.08 U11.2
$1I715/$1N10629: length 3.9
  Top Layer w0.305: U12.2 5.29,14.35 6.28,15.34 8.03,15.34
$1I715/$1N10667: length 7.1
  Top Layer w0.305: U13.2 5.86,15.62 6.08,15.84 U2.28
$1I715/$1N10705: length 3.7
  Top Layer w0.305: U14.2 6.37,16.89 6.92,16.34 8.03,16.34
$1I715/$1N10743: length 7.6
  Top Layer w0.305: U15.2 5.87,18.27 7.31,16.84 U2.26
$1I715/$1N10781: length 4.3
  Top Layer w0.305: U16.2 5.94,19.43 8.03,17.34
$1I715/$1N10830: length 8.5
  Top Layer w0.305: U2.24 6.54,20.19 6.54,25.65
$1I715/$1N10868: length 4.7
  Top Layer w0.305: U18.1 7.76,22.1 7.76,20.95 9.21,19.51 U2.23
$1I715/$1N10906: length 8.1
  Top Layer w0.305: U19.1 9.01,24.91 9.03,24.89 9.03,20.83 9.71,20.15 U2.22
$1I715/$1N10944: length 4.1
  Top Layer w0.305: U2.21 10.21,22.07 U20.1
$1I715/$1N10982: length 8.1
  Top Layer w0.305: U2.20 10.68,18.04 10.68,20.32 11.49,21.12 U21.1
$1I715/$1N11020: length 4.7
  Top Layer w0.305: U2.19 11.19,18.04 11.19,20.07 12.72,21.6 U22.1
$1I715/$1N11058: length 8.2
  Top Layer w0.305: 13.96,25.75 13.86,25.64 13.86,21.46 12.71,20.32 12.71,18.02
$1I715/$1N11162: length 4.9
  Top Layer w0.305: U24.1 13.21,20.13 U2.15
$1I715/$1N11200: length 8.8
  Top Layer w0.305: 13.71,18.02 13.71,18.9 16.43,21.62 U25.1
$1I715/$1N11238: length 5.5
  Top Layer w0.305: U26.1 14.21,18.66 U2.13
$1I715/$1N11679: length 3.5
  Top Layer w0.305: U2.48 14.21,10.55 C35.1
$1I715/$1N11690: length 2.1
  Top Layer w0.305: v1(16.67,11.18) 15.55,11.18 U2.1

## Text on the board
Top Silkscreen Layer: TX[QN, QP, IN, IP] | RX[QN, QP, IN, IP] | PACHECKO
